# Altium schematic sheet Minion.SchDoc (part 1 of 4) (continued)
## Parts
C1  10uF/16V  [SMD_0805_CAPC2012X145N]
C1P_1  10uF/16V  [SMD_0805_CAPC2012X145N]
C1P_2  10uF/16V  [SMD_0805_CAPC2012X145N]
C1P_3  10uF/16V  [SMD_0805_CAPC2012X145N]
C1P_4  10uF/16V  [SMD_0805_CAPC2012X145N]
C1P_5  10uF/16V  [SMD_0805_CAPC2012X145N]
C1P_6  10uF/16V  [SMD_0805_CAPC2012X145N]
C1P_7  10uF/16V  [SMD_0805_CAPC2012X145N]
C1P_8  10uF/16V  [SMD_0805_CAPC2012X145N]
C2  1nF  [SMD_0603_CAPC1608X80N]
C2P_1  1uF/16V  [SMD_0805_CAPC2012X145N]
C2P_2  1uF/16V  [SMD_0805_CAPC2012X145N]
C2P_3  1uF/16V  [SMD_0805_CAPC2012X145N]
C2P_4  1uF/16V  [SMD_0805_CAPC2012X145N]
C2P_5  1uF/16V  [SMD_0805_CAPC2012X145N]
C2P_6  1uF/16V  [SMD_0805_CAPC2012X145N]
C2P_7  1uF/16V  [SMD_0805_CAPC2012X145N]
C2P_8  1uF/16V  [SMD_0805_CAPC2012X145N]
C3  1nF  [SMD_0603_CAPC1608X80N]
C3P_1  100nF/50V  [SMD_0805_CAPC2012X145N]
C3P_2  100nF/50V  [SMD_0805_CAPC2012X145N]
C3P_3  100nF/50V  [SMD_0805_CAPC2012X145N]
C3P_4  100nF/50V  [SMD_0805_CAPC2012X145N]
C3P_5  100nF/50V  [SMD_0805_CAPC2012X145N]
C3P_6  100nF/50V  [SMD_0805_CAPC2012X145N]
C3P_7  100nF/50V  [SMD_0805_CAPC2012X145N]
C3P_8  100nF/50V  [SMD_0805_CAPC2012X145N]
C4  100nF  [SMD_0603_CAPC1608X80N]
C4P_1  22uF/16V  [SMD_1210_CAPC3225X279N]
C4P_2  22uF/16V  [SMD_1210_CAPC3225X279N]
C4P_3  22uF/16V  [SMD_1210_CAPC3225X279N]
C4P_4  22uF/16V  [SMD_1210_CAPC3225X279N]
C4P_5  22uF/16V  [SMD_1210_CAPC3225X279N]
C4P_6  22uF/16V  [SMD_1210_CAPC3225X279N]
C4P_7  22uF/16V  [SMD_1210_CAPC3225X279N]
C4P_8  22uF/16V  [SMD_1210_CAPC3225X279N]
C5P_1  22uF/16V  [SMD_1210_CAPC3225X279N]
C5P_2  22uF/16V  [SMD_1210_CAPC3225X279N]
C5P_3  22uF/16V  [SMD_1210_CAPC3225X279N]
C5P_4  22uF/16V  [SMD_1210_CAPC3225X279N]
C5P_5  22uF/16V  [SMD_1210_CAPC3225X279N]
C5P_6  22uF/16V  [SMD_1210_CAPC3225X279N]
C5P_7  22uF/16V  [SMD_1210_CAPC3225X279N]
C5P_8  22uF/16V  [SMD_1210_CAPC3225X279N]
C6P_1  220uF  [SMD_1210_CAPC3225X279N]
C6P_2  220uF  [SMD_1210_CAPC3225X279N]
C6P_3  220uF  [SMD_1210_CAPC3225X279N]
C6P_4  220uF  [SMD_1210_CAPC3225X279N]
C6P_5  220uF  [SMD_1210_CAPC3225X279N]
C6P_6  220uF  [SMD_1210_CAPC3225X279N]
C6P_7  220uF  [SMD_1210_CAPC3225X279N]
C6P_8  220uF  [SMD_1210_CAPC3225X279N]
C7  100nF  [SMD_0603_CAPC1608X80N]
C7P_1  220uF  [SMD_1210_CAPC3225X279N]
C7P_2  220uF  [SMD_1210_CAPC3225X279N]
C7P_3  220uF  [SMD_1210_CAPC3225X279N]
C7P_4  220uF  [SMD_1210_CAPC3225X279N]
C7P_5  220uF  [SMD_1210_CAPC3225X279N]
C7P_6  220uF  [SMD_1210_CAPC3225X279N]
C7P_7  220uF  [SMD_1210_CAPC3225X279N]
C7P_8  220uF  [SMD_1210_CAPC3225X279N]
C8  100nF  [SMD_0603_CAPC1608X80N]
C8P_1  220uF  [SMD_1210_CAPC3225X279N]
C8P_2  220uF  [SMD_1210_CAPC3225X279N]
C8P_3  220uF  [SMD_1210_CAPC3225X279N]
C8P_4  220uF  [SMD_1210_CAPC3225X279N]
C8P_5  220uF  [SMD_1210_CAPC3225X279N]
C8P_6  220uF  [SMD_1210_CAPC3225X279N]
C8P_7  220uF  [SMD_1210_CAPC3225X279N]
C8P_8  220uF  [SMD_1210_CAPC3225X279N]
C9  100nF  [SMD_0603_CAPC1608X80N]
C9P_1  22uF/16V  [SMD_1210_CAPC3225X279N]
C9P_2  22uF/16V  [SMD_1210_CAPC3225X279N]
C9P_3  22uF/16V  [SMD_1210_CAPC3225X279N]
C9P_4  22uF/16V  [SMD_1210_CAPC3225X279N]
C9P_5  22uF/16V  [SMD_1210_CAPC3225X279N]
C9P_6  22uF/16V  [SMD_1210_CAPC3225X279N]
C9P_7  22uF/16V  [SMD_1210_CAPC3225X279N]
C9P_8  22uF/16V  [SMD_1210_CAPC3225X279N]
C10  100nF  [SMD_0603_CAPC1608X80N]
C10P_1  22uF/16V  [SMD_1210_CAPC3225X279N]
C10P_2  22uF/16V  [SMD_1210_CAPC3225X279N]
C10P_3  22uF/16V  [SMD_1210_CAPC3225X279N]
C10P_4  22uF/16V  [SMD_1210_CAPC3225X279N]
C10P_5  22uF/16V  [SMD_1210_CAPC3225X279N]
C10P_6  22uF/16V  [SMD_1210_CAPC3225X279N]
C10P_7  22uF/16V  [SMD_1210_CAPC3225X279N]
C10P_8  22uF/16V  [SMD_1210_CAPC3225X279N]
C11  100nF  [SMD_0603_CAPC1608X80N]
C11P_1  22uF/16V  [SMD_1210_CAPC3225X279N]
C11P_2  22uF/16V  [SMD_1210_CAPC3225X279N]
C11P_3  22uF/16V  [SMD_1210_CAPC3225X279N]
C11P_4  22uF/16V  [SMD_1210_CAPC3225X279N]
C11P_5  22uF/16V  [SMD_1210_CAPC3225X279N]
C11P_6  22uF/16V  [SMD_1210_CAPC3225X279N]
C11P_7  22uF/16V  [SMD_1210_CAPC3225X279N]
C11P_8  22uF/16V  [SMD_1210_CAPC3225X279N]
C12  18pF  [SMD_0603_CAPC1608X80N]
C12P_1  22uF/16V  [SMD_1210_CAPC3225X279N]
C12P_2  22uF/16V  [SMD_1210_CAPC3225X279N]
C12P_3  22uF/16V  [SMD_1210_CAPC3225X279N]
C12P_4  22uF/16V  [SMD_1210_CAPC3225X279N]
C12P_5  22uF/16V  [SMD_1210_CAPC3225X279N]
C12P_6  22uF/16V  [SMD_1210_CAPC3225X279N]
C12P_7  22uF/16V  [SMD_1210_CAPC3225X279N]
C12P_8  22uF/16V  [SMD_1210_CAPC3225X279N]
C13  18pF  [SMD_0603_CAPC1608X80N]
C14  10uF/16V  [SMD_0805_CAPC2012X145N]
C15  10uF/16V  [SMD_0805_CAPC2012X145N]
C16  (OPT)220uF  [SMD_1210_CAPC3225X279N]
C17  22uF/6.3V  [SMD_0805_CAPC2012X145N]
C25  22uF/6.3V  [SMD_0805_CAPC2012X145N]
C26  22uF/6.3V  [SMD_0805_CAPC2012X145N]
CF_1  (OPT)1uF  [SMD_1210_CAPC3225X279N]
CF_2  (OPT)1uF  [SMD_1210_CAPC3225X279N]
CF_3  (OPT)1uF  [SMD_1210_CAPC3225X279N]
CF_4  (OPT)1uF  [SMD_1210_CAPC3225X279N]
CF_5  (OPT)1uF  [SMD_1210_CAPC3225X279N]
CF_6  (OPT)1uF  [SMD_1210_CAPC3225X279N]
CF_7  (OPT)1uF  [SMD_1210_CAPC3225X279N]
CF_8  (OPT)1uF  [SMD_1210_CAPC3225X279N]
CF_9  (OPT)1uF  [SMD_1210_CAPC3225X279N]
CF_10  (OPT)1uF  [SMD_1210_CAPC3225X279N]
CF_11  (OPT)1uF  [SMD_1210_CAPC3225X279N]
CF_12  (OPT)1uF  [SMD_1210_CAPC3225X279N]
CF_13  (OPT)1uF  [SMD_1210_CAPC3225X279N]
CF_14  (OPT)1uF  [SMD_1210_CAPC3225X279N]
CF_15  (OPT)1uF  [SMD_1210_CAPC3225X279N]
CF_16  (OPT)1uF  [SMD_1210_CAPC3225X279N]
CF_17  (OPT)1uF  [SMD_1210_CAPC3225X279N]
CF_18  (OPT)1uF  [SMD_1210_CAPC3225X279N]
CF_19  (OPT)1uF  [SMD_1210_CAPC3225X279N]
CF_20  (OPT)1uF  [SMD_1210_CAPC3225X279N]
CF_21  (OPT)1uF  [SMD_1210_CAPC3225X279N]
CF_22  (OPT)1uF  [SMD_1210_CAPC3225X279N]
CF_23  (OPT)1uF  [SMD_1210_CAPC3225X279N]
CF_24  (OPT)1uF  [SMD_1210_CAPC3225X279N]
CF_25  (OPT)1uF  [SMD_1210_CAPC3225X279N]
CF_26  (OPT)1uF  [SMD_1210_CAPC3225X279N]
CF_27  (OPT)1uF  [SMD_1210_CAPC3225X279N]
CF_28  (OPT)1uF  [SMD_1210_CAPC3225X279N]
CF_29  (OPT)1uF  [SMD_1210_CAPC3225X279N]
CF_30  (OPT)1uF  [SMD_1210_CAPC3225X279N]
CF_31  (OPT)1uF  [SMD_1210_CAPC3225X279N]
CF_32  (OPT)1uF  [SMD_1210_CAPC3225X279N]
CF_33  (OPT)1uF  [SMD_1210_CAPC3225X279N]
CF_34  (OPT)1uF  [SMD_1210_CAPC3225X279N]
CF_35  (OPT)1uF  [SMD_1210_CAPC3225X279N]
CF_36  (OPT)1uF  [SMD_1210_CAPC3225X279N]
CF_37  (OPT)1uF  [SMD_1210_CAPC3225X279N]
CF_38  (OPT)1uF  [SMD_1210_CAPC3225X279N]
CF_39  (OPT)1uF  [SMD_1210_CAPC3225X279N]
CF_40  (OPT)1uF  [SMD_1210_CAPC3225X279N]
CF_41  (OPT)1uF  [SMD_1210_CAPC3225X279N]
CF_42  (OPT)1uF  [SMD_1210_CAPC3225X279N]
CF_43  (OPT)1uF  [SMD_1210_CAPC3225X279N]
CF_44  (OPT)1uF  [SMD_1210_CAPC3225X279N]
CF_45  (OPT)1uF  [SMD_1210_CAPC3225X279N]
CF_46  (OPT)1uF  [SMD_1210_CAPC3225X279N]
CF_47  (OPT)1uF  [SMD_1210_CAPC3225X279N]
CF_48  (OPT)1uF  [SMD_1210_CAPC3225X279N]
CF_49  (OPT)1uF  [SMD_1210_CAPC3225X279N]
CF_50  (OPT)1uF  [SMD_1210_CAPC3225X279N]
CF_51  (OPT)1uF  [SMD_1210_CAPC3225X279N]
CF_52  (OPT)1uF  [SMD_1210_CAPC3225X279N]
CF_53  (OPT)1uF  [SMD_1210_CAPC3225X279N]
CF_54  (OPT)1uF  [SMD_1210_CAPC3225X279N]
CF_55  (OPT)1uF  [SMD_1210_CAPC3225X279N]
CF_56  (OPT)1uF  [SMD_1210_CAPC3225X279N]
CF_57  (OPT)1uF  [SMD_1210_CAPC3225X279N]
CF_58  (OPT)1uF  [SMD_1210_CAPC3225X279N]
CF_59  (OPT)1uF  [SMD_1210_CAPC3225X279N]
CF_60  (OPT)1uF  [SMD_1210_CAPC3225X279N]
CF_61  (OPT)1uF  [SMD_1210_CAPC3225X279N]
CF_62  (OPT)1uF  [SMD_1210_CAPC3225X279N]
CF_63  (OPT)1uF  [SMD_1210_CAPC3225X279N]
CF_64  (OPT)1uF  [SMD_1210_CAPC3225X279N]
CF_65  (OPT)1uF  [SMD_1210_CAPC3225X279N]
CF_66  (OPT)1uF  [SMD_1210_CAPC3225X279N]
CF_67  (OPT)1uF  [SMD_1210_CAPC3225X279N]
CF_68  (OPT)1uF  [SMD_1210_CAPC3225X279N]
CF_69  (OPT)1uF  [SMD_1210_CAPC3225X279N]
CF_70  (OPT)1uF  [SMD_1210_CAPC3225X279N]
CF_71  (OPT)1uF  [SMD_1210_CAPC3225X279N]
CF_72  (OPT)1uF  [SMD_1210_CAPC3225X279N]
CF_73  (OPT)1uF  [SMD_1210_CAPC3225X279N]
CF_74  (OPT)1uF  [SMD_1210_CAPC3225X279N]
CF_75  (OPT)1uF  [SMD_1210_CAPC3225X279N]
CF_76  (OPT)1uF  [SMD_1210_CAPC3225X279N]
CF_77  (OPT)1uF  [SMD_1210_CAPC3225X279N]
CF_78  (OPT)1uF  [SMD_1210_CAPC3225X279N]
CF_79  (OPT)1uF  [SMD_1210_CAPC3225X279N]
CF_80  (OPT)1uF  [SMD_1210_CAPC3225X279N]
CF_81  (OPT)1uF  [SMD_1210_CAPC3225X279N]
CF_82  (OPT)1uF  [SMD_1210_CAPC3225X279N]
CF_83  (OPT)1uF  [SMD_1210_CAPC3225X279N]
CF_84  (OPT)1uF  [SMD_1210_CAPC3225X279N]
CF_85  (OPT)1uF  [SMD_1210_CAPC3225X279N]
CF_86  (OPT)1uF  [SMD_1210_CAPC3225X279N]
CF_87  (OPT)1uF  [SMD_1210_CAPC3225X279N]
CF_88  (OPT)1uF  [SMD_1210_CAPC3225X279N]
CF_89  (OPT)1uF  [SMD_1210_CAPC3225X279N]
CF_90  (OPT)1uF  [SMD_1210_CAPC3225X279N]
CF_91  (OPT)1uF  [SMD_1210_CAPC3225X279N]
CF_92  (OPT)1uF  [SMD_1210_CAPC3225X279N]
CF_93  (OPT)1uF  [SMD_1210_CAPC3225X279N]
CF_94  (OPT)1uF  [SMD_1210_CAPC3225X279N]
CF_95  (OPT)1uF  [SMD_1210_CAPC3225X279N]
CF_96  (OPT)1uF  [SMD_1210_CAPC3225X279N]
CF_97  (OPT)1uF  [SMD_1210_CAPC3225X279N]
CF_98  (OPT)1uF  [SMD_1210_CAPC3225X279N]
CF_99  (OPT)1uF  [SMD_1210_CAPC3225X279N]
CF_100  (OPT)1uF  [SMD_1210_CAPC3225X279N]
CF_101  (OPT)1uF  [SMD_1210_CAPC3225X279N]
CF_102  (OPT)1uF  [SMD_1210_CAPC3225X279N]
CF_103  (OPT)1uF  [SMD_1210_CAPC3225X279N]
CF_104  (OPT)1uF  [SMD_1210_CAPC3225X279N]
CF_105  (OPT)1uF  [SMD_1210_CAPC3225X279N]
CF_106  (OPT)1uF  [SMD_1210_CAPC3225X279N]
CF_107  (OPT)1uF  [SMD_1210_CAPC3225X279N]
CF_108  (OPT)1uF  [SMD_1210_CAPC3225X279N]
CF_109  (OPT)1uF  [SMD_1210_CAPC3225X279N]
CF_110  (OPT)1uF  [SMD_1210_CAPC3225X279N]
CF_111  (OPT)1uF  [SMD_1210_CAPC3225X279N]
CF_112  (OPT)1uF  [SMD_1210_CAPC3225X279N]
CM_1  1uF  [SMD_1210_CAPC3225X279N]
CM_2  1uF  [SMD_1210_CAPC3225X279N]
CM_3  1uF  [SMD_1210_CAPC3225X279N]
CM_4  1uF  [SMD_1210_CAPC3225X279N]
CM_5  1uF  [SMD_1210_CAPC3225X279N]
CM_6  1uF  [SMD_1210_CAPC3225X279N]
CM_7  1uF  [SMD_1210_CAPC3225X279N]
CM_8  1uF  [SMD_1210_CAPC3225X279N]
CM_9  1uF  [SMD_1210_CAPC3225X279N]
CM_10  1uF  [SMD_1210_CAPC3225X279N]
CM_11  1uF  [SMD_1210_CAPC3225X279N]
CM_12  1uF  [SMD_1210_CAPC3225X279N]
CM_13  1uF  [SMD_1210_CAPC3225X279N]
CM_14  1uF  [SMD_1210_CAPC3225X279N]
CM_15  1uF  [SMD_1210_CAPC3225X279N]
CM_16  1uF  [SMD_1210_CAPC3225X279N]
CM_17  1uF  [SMD_1210_CAPC3225X279N]
CM_18  1uF  [SMD_1210_CAPC3225X279N]
CM_19  1uF  [SMD_1210_CAPC3225X279N]
CM_20  1uF  [SMD_1210_CAPC3225X279N]
CM_21  1uF  [SMD_1210_CAPC3225X279N]
CM_22  1uF  [SMD_1210_CAPC3225X279N]
CM_23  1uF  [SMD_1210_CAPC3225X279N]
CM_24  1uF  [SMD_1210_CAPC3225X279N]
CM_25  1uF  [SMD_1210_CAPC3225X279N]
CM_26  1uF  [SMD_1210_CAPC3225X279N]
CM_27  1uF  [SMD_1210_CAPC3225X279N]
CM_28  1uF  [SMD_1210_CAPC3225X279N]
CM_29  1uF  [SMD_1210_CAPC3225X279N]
CM_30  1uF  [SMD_1210_CAPC3225X279N]
CM_31  1uF  [SMD_1210_CAPC3225X279N]
CM_32  1uF  [SMD_1210_CAPC3225X279N]
CM_33  1uF  [SMD_1210_CAPC3225X279N]
CM_34  1uF  [SMD_1210_CAPC3225X279N]
CM_35  1uF  [SMD_1210_CAPC3225X279N]
CM_36  1uF  [SMD_1210_CAPC3225X279N]
CM_37  1uF  [SMD_1210_CAPC3225X279N]
CM_38  1uF  [SMD_1210_CAPC3225X279N]
CM_39  1uF  [SMD_1210_CAPC3225X279N]
CM_40  1uF  [SMD_1210_CAPC3225X279N]
CM_41  1uF  [SMD_1210_CAPC3225X279N]
CM_42  1uF  [SMD_1210_CAPC3225X279N]
CM_43  1uF  [SMD_1210_CAPC3225X279N]
CM_44  1uF  [SMD_1210_CAPC3225X279N]
CM_45  1uF  [SMD_1210_CAPC3225X279N]
CM_46  1uF  [SMD_1210_CAPC3225X279N]
CM_47  1uF  [SMD_1210_CAPC3225X279N]
CM_48  1uF  [SMD_1210_CAPC3225X279N]
CM_49  1uF  [SMD_1210_CAPC3225X279N]
CM_50  1uF  [SMD_1210_CAPC3225X279N]
CM_51  1uF  [SMD_1210_CAPC3225X279N]
CM_52  1uF  [SMD_1210_CAPC3225X279N]
CM_53  1uF  [SMD_1210_CAPC3225X279N]
CM_54  1uF  [SMD_1210_CAPC3225X279N]
CM_55  1uF  [SMD_1210_CAPC3225X279N]
CM_56  1uF  [SMD_1210_CAPC3225X279N]
CM_57  1uF  [SMD_1210_CAPC3225X279N]
CM_58  1uF  [SMD_1210_CAPC3225X279N]
CM_59  1uF  [SMD_1210_CAPC3225X279N]
CM_60  1uF  [SMD_1210_CAPC3225X279N]
CM_61  1uF  [SMD_1210_CAPC3225X279N]
CM_62  1uF  [SMD_1210_CAPC3225X279N]
CM_63  1uF  [SMD_1210_CAPC3225X279N]
CM_64  1uF  [SMD_1210_CAPC3225X279N]
CM_65  1uF  [SMD_1210_CAPC3225X279N]
CM_66  1uF  [SMD_1210_CAPC3225X279N]
CM_67  1uF  [SMD_1210_CAPC3225X279N]
CM_68  1uF  [SMD_1210_CAPC3225X279N]
CM_69  1uF  [SMD_1210_CAPC3225X279N]
CM_70  1uF  [SMD_1210_CAPC3225X279N]
CM_71  1uF  [SMD_1210_CAPC3225X279N]
CM_72  1uF  [SMD_1210_CAPC3225X279N]
CM_73  1uF  [SMD_1210_CAPC3225X279N]
CM_74  1uF  [SMD_1210_CAPC3225X279N]
CM_75  1uF  [SMD_1210_CAPC3225X279N]
CM_76  1uF  [SMD_1210_CAPC3225X279N]
CM_77  1uF  [SMD_1210_CAPC3225X279N]
CM_78  1uF  [SMD_1210_CAPC3225X279N]
CM_79  1uF  [SMD_1210_CAPC3225X279N]
CM_80  1uF  [SMD_1210_CAPC3225X279N]
CM_81  1uF  [SMD_1210_CAPC3225X279N]
CM_82  1uF  [SMD_1210_CAPC3225X279N]
CM_83  1uF  [SMD_1210_CAPC3225X279N]
CM_84  1uF  [SMD_1210_CAPC3225X279N]
CM_85  1uF  [SMD_1210_CAPC3225X279N]
CM_86  1uF  [SMD_1210_CAPC3225X279N]
CM_87  1uF  [SMD_1210_CAPC3225X279N]
CM_88  1uF  [SMD_1210_CAPC3225X279N]
CM_89  1uF  [SMD_1210_CAPC3225X279N]
CM_90  1uF  [SMD_1210_CAPC3225X279N]
CM_91  1uF  [SMD_1210_CAPC3225X279N]
CM_92  1uF  [SMD_1210_CAPC3225X279N]
CM_93  1uF  [SMD_1210_CAPC3225X279N]
CM_94  1uF  [SMD_1210_CAPC3225X279N]
CM_95  1uF  [SMD_1210_CAPC3225X279N]
CM_96  1uF  [SMD_1210_CAPC3225X279N]
CM_97  1uF  [SMD_1210_CAPC3225X279N]
CM_98  1uF  [SMD_1210_CAPC3225X279N]
CM_99  1uF  [SMD_1210_CAPC3225X279N]
CM_100  1uF  [SMD_1210_CAPC3225X279N]
CM_101  1uF  [SMD_1210_CAPC3225X279N]
CM_102  1uF  [SMD_1210_CAPC3225X279N]
CM_103  1uF  [SMD_1210_CAPC3225X279N]
CM_104  1uF  [SMD_1210_CAPC3225X279N]
CM_105  1uF  [SMD_1210_CAPC3225X279N]
CM_106  1uF  [SMD_1210_CAPC3225X279N]
CM_107  1uF  [SMD_1210_CAPC3225X279N]
CM_108  1uF  [SMD_1210_CAPC3225X279N]
CM_109  1uF  [SMD_1210_CAPC3225X279N]
CM_110  1uF  [SMD_1210_CAPC3225X279N]
CM_111  1uF  [SMD_1210_CAPC3225X279N]
CM_112  1uF  [SMD_1210_CAPC3225X279N]
CO1_1  1nF  [SMD_0603_CAPC1608X80N]
CO1_2  1nF  [SMD_0603_CAPC1608X80N]
CO1_3  1nF  [SMD_0603_CAPC1608X80N]
CO1_4  1nF  [SMD_0603_CAPC1608X80N]
CO2_1  100nF  [SMD_0603_CAPC1608X80N]
CO2_2  100nF  [SMD_0603_CAPC1608X80N]
CO2_3  100nF  [SMD_0603_CAPC1608X80N]
CO2_4  100nF  [SMD_0603_CAPC1608X80N]
CO3_1  220uF  [SMD_1210_CAPC3225X279N]
CO3_2  220uF  [SMD_1210_CAPC3225X279N]
CO3_3  220uF  [SMD_1210_CAPC3225X279N]
CO3_4  220uF  [SMD_1210_CAPC3225X279N]
CO4_1  22uF/6.3V  [SMD_0805_CAPC2012X145N]
CO4_2  22uF/6.3V  [SMD_0805_CAPC2012X145N]
CO4_3  22uF/6.3V  [SMD_0805_CAPC2012X145N]
CO4_4  22uF/6.3V  [SMD_0805_CAPC2012X145N]
CO5_1  (OPT)1nF  [SMD_0603_CAPC1608X80N]
CO5_2  (OPT)1nF  [SMD_0603_CAPC1608X80N]
CO5_3  (OPT)1nF  [SMD_0603_CAPC1608X80N]
CO5_4  (OPT)1nF  [SMD_0603_CAPC1608X80N]
CO6_1  (OPT)1nF  [SMD_0603_CAPC1608X80N]
CO6_2  (OPT)1nF  [SMD_0603_CAPC1608X80N]
CO6_3  (OPT)1nF  [SMD_0603_CAPC1608X80N]
CO6_4  (OPT)1nF  [SMD_0603_CAPC1608X80N]
CO7_1  470nF  [SMD_0603_CAPC1608X80N]
CO7_2  470nF  [SMD_0603_CAPC1608X80N]
CO7_3  470nF  [SMD_0603_CAPC1608X80N]
CO7_4  470nF  [SMD_0603_CAPC1608X80N]
CO8_1  100nF  [SMD_0603_CAPC1608X80N]
CO8_2  100nF  [SMD_0603_CAPC1608X80N]
CO8_3  100nF  [SMD_0603_CAPC1608X80N]
CO8_4  100nF  [SMD_0603_CAPC1608X80N]
D1  Red SML210VT ROHM  [SMD_0805_LED2012X100N]
D1P_1  BAT54C  [SMD_SOT23_SOT95P240X120-3N]
D1P_2  BAT54C  [SMD_SOT23_SOT95P240X120-3N]
D1P_3  BAT54C  [SMD_SOT23_SOT95P240X120-3N]
D1P_4  BAT54C  [SMD_SOT23_SOT95P240X120-3N]
D1P_5  BAT54C  [SMD_SOT23_SOT95P240X120-3N]
D1P_6  BAT54C  [SMD_SOT23_SOT95P240X120-3N]
D1P_7  BAT54C  [SMD_SOT23_SOT95P240X120-3N]
D1P_8  BAT54C  [SMD_SOT23_SOT95P240X120-3N]
D2  Green 	SML210MT ROHM  [SMD_0805_LED2012X100N]
D3  Yellow SML210YT ROHM  [SMD_0805_LED2012X100N]
D4  Orange 	SML210DT ROHM  [SMD_0805_LED2012X100N]
D5  SMS05T1G  [SMD_SOT95P280X145-6N-W]
D6  SMCJ12A  [SMD_DO214AC_SMC]
D7  (OPT)SS14  [SMD_DO214AC_SMA]
D8  (OPT)SS14  [SMD_DO214AC_SMA]
D9  SS14  [SMD_DO214AC_SMA]
D10  SMCJ12A  [SMD_DO214AC_SMC]
D11  SMCJ12A  [SMD_DO214AC_SMC]
D12  SMCJ12A  [SMD_DO214AC_SMC]
DI1_1  Red SML210VT ROHM  [SMD_0805_LED2012X100N]
DI1_2  Red SML210VT ROHM  [SMD_0805_LED2012X100N]
DI1_3  Red SML210VT ROHM  [SMD_0805_LED2012X100N]
DI1_4  Red SML210VT ROHM  [SMD_0805_LED2012X100N]
DI2_1  Green 	SML210MT ROHM  [SMD_0805_LED2012X100N]
DI2_2  Green 	SML210MT ROHM  [SMD_0805_LED2012X100N]
DI2_3  Green 	SML210MT ROHM  [SMD_0805_LED2012X100N]
DI2_4  Green 	SML210MT ROHM  [SMD_0805_LED2012X100N]
DI3_1  Yellow SML210YT ROHM  [SMD_0805_LED2012X100N]
DI3_2  Yellow SML210YT ROHM  [SMD_0805_LED2012X100N]
DI3_3  Yellow SML210YT ROHM  [SMD_0805_LED2012X100N]
DI3_4  Yellow SML210YT ROHM  [SMD_0805_LED2012X100N]
DI4_1  (OPT)Orange 	SML210DT ROHM  [SMD_0805_LED2012X100N]
DI4_2  (OPT)Orange 	SML210DT ROHM  [SMD_0805_LED2012X100N]
DI4_3  (OPT)Orange 	SML210DT ROHM  [SMD_0805_LED2012X100N]
DI4_4  (OPT)Orange 	SML210DT ROHM  [SMD_0805_LED2012X100N]
DI5_1  (OPT)Red SML210VT ROHM  [SMD_0805_LED2012X100N]
DI5_2  (OPT)Red SML210VT ROHM  [SMD_0805_LED2012X100N]
DI5_3  (OPT)Red SML210VT ROHM  [SMD_0805_LED2012X100N]
DI5_4  (OPT)Red SML210VT ROHM  [SMD_0805_LED2012X100N]
DI6_1  (OPT)Green 	SML210MT ROHM  [SMD_0805_LED2012X100N]
DI6_2  (OPT)Green 	SML210MT ROHM  [SMD_0805_LED2012X100N]
DI6_3  (OPT)Green 	SML210MT ROHM  [SMD_0805_LED2012X100N]
DI6_4  (OPT)Green 	SML210MT ROHM  [SMD_0805_LED2012X100N]
DI7_1  (OPT)Yellow SML210YT ROHM  [SMD_0805_LED2012X100N]
DI7_2  (OPT)Yellow SML210YT ROHM  [SMD_0805_LED2012X100N]
DI7_3  (OPT)Yellow SML210YT ROHM  [SMD_0805_LED2012X100N]
DI7_4  (OPT)Yellow SML210YT ROHM  [SMD_0805_LED2012X100N]
DI8_1  Orange 	SML210DT ROHM  [SMD_0805_LED2012X100N]
DI8_2  Orange 	SML210DT ROHM  [SMD_0805_LED2012X100N]
DI8_3  Orange 	SML210DT ROHM  [SMD_0805_LED2012X100N]
DI8_4  Orange 	SML210DT ROHM  [SMD_0805_LED2012X100N]
DI9_1  (OPT)Yellow SML210YT ROHM  [SMD_0805_LED2012X100N]
DI9_2  (OPT)Yellow SML210YT ROHM  [SMD_0805_LED2012X100N]
DI9_3  (OPT)Yellow SML210YT ROHM  [SMD_0805_LED2012X100N]
DI9_4  (OPT)Yellow SML210YT ROHM  [SMD_0805_LED2012X100N]
J1  (OPT) CON PROGRAM  [SIP5 PGM TOP]
J2  CU04SCM15B0-R0  [SMD_CON-CVILUX-CU04-SCM15B0]
J4  WURTH 649 006 295 22  [PTH_CON_PCI-E]
J5  BGA FAN  [SMD_BGA900_FAN]
J6  BGA FAN  [SMD_BGA900_FAN]
J7  BGA FAN  [SMD_BGA900_FAN]
J8  BGA FAN  [SMD_BGA900_FAN]
J9  WURTH 649 006 295 22  [PTH_CON_PCI-E]
J10  WURTH 649 006 295 22  [PTH_CON_PCI-E]
J12  CON FAN  [PTH_CON_PANCON-MPSS100-04D]
J13  CON FAN  [PTH_CON_PANCON-MPSS100-04D]
J14  CON FAN  [PTH_CON_PANCON-MPSS100-04D]
J15  CON FAN  [PTH_CON_PANCON-MPSS100-04D]
L1P_1  SLC1480-201MLD  [SMD_INDM12501250X800A - Coilcraft SLC1480]
L1P_2  SLC1480-201MLD  [SMD_INDM12501250X800A - Coilcraft SLC1480]
L1P_3  SLC1480-201MLD  [SMD_INDM12501250X800A - Coilcraft SLC1480]
L1P_4  SLC1480-201MLD  [SMD_INDM12501250X800A - Coilcraft SLC1480]
L1P_5  SLC1480-201MLD  [SMD_INDM12501250X800A - Coilcraft SLC1480]
L1P_6  SLC1480-201MLD  [SMD_INDM12501250X800A - Coilcraft SLC1480]
L1P_7  SLC1480-201MLD  [SMD_INDM12501250X800A - Coilcraft SLC1480]
L1P_8  SLC1480-201MLD  [SMD_INDM12501250X800A - Coilcraft SLC1480]
Q1P_1  AP1RA03GMT-3  [SMD_SON127P615X520X100-8N]
Q1P_2  AP1RA03GMT-3  [SMD_SON127P615X520X100-8N]
Q1P_3  AP1RA03GMT-3  [SMD_SON127P615X520X100-8N]
Q1P_4  AP1RA03GMT-3  [SMD_SON127P615X520X100-8N]
Q1P_5  AP1RA03GMT-3  [SMD_SON127P615X520X100-8N]
Q1P_6  AP1RA03GMT-3  [SMD_SON127P615X520X100-8N]
Q1P_7  AP1RA03GMT-3  [SMD_SON127P615X520X100-8N]
Q1P_8  AP1RA03GMT-3  [SMD_SON127P615X520X100-8N]
Q2P_1  AP1RA03GMT-3  [SMD_SON127P615X520X100-8N]
Q2P_2  AP1RA03GMT-3  [SMD_SON127P615X520X100-8N]
Q2P_3  AP1RA03GMT-3  [SMD_SON127P615X520X100-8N]
Q2P_4  AP1RA03GMT-3  [SMD_SON127P615X520X100-8N]
Q2P_5  AP1RA03GMT-3  [SMD_SON127P615X520X100-8N]
Q2P_6  AP1RA03GMT-3  [SMD_SON127P615X520X100-8N]
Q2P_7  AP1RA03GMT-3  [SMD_SON127P615X520X100-8N]
Q2P_8  AP1RA03GMT-3  [SMD_SON127P615X520X100-8N]
Q3P_1  AP1RA03GMT-3  [SMD_SON127P615X520X100-8N]
Q3P_2  AP1RA03GMT-3  [SMD_SON127P615X520X100-8N]
Q3P_3  AP1RA03GMT-3  [SMD_SON127P615X520X100-8N]
Q3P_4  AP1RA03GMT-3  [SMD_SON127P615X520X100-8N]
Q3P_5  AP1RA03GMT-3  [SMD_SON127P615X520X100-8N]
Q3P_6  AP1RA03GMT-3  [SMD_SON127P615X520X100-8N]
Q3P_7  AP1RA03GMT-3  [SMD_SON127P615X520X100-8N]
Q3P_8  AP1RA03GMT-3  [SMD_SON127P615X520X100-8N]
QO1_1  (OPT)BSS138  [SMD_SOT23_SOT95P240X120-3N]
QO1_2  (OPT)BSS138  [SMD_SOT23_SOT95P240X120-3N]
QO1_3  (OPT)BSS138  [SMD_SOT23_SOT95P240X120-3N]
QO1_4  (OPT)BSS138  [SMD_SOT23_SOT95P240X120-3N]
R1  10k  [SMD_0603_RESC1608X55N]
R2  10k  [SMD_0603_RESC1608X55N]
R3  10k  [SMD_0603_RESC1608X55N]
R4  10k  [SMD_0603_RESC1608X55N]
R9  10k  [SMD_0603_RESC1608X55N]
R10  10k  [SMD_0603_RESC1608X55N]
R11  10k  [SMD_0603_RESC1608X55N]
R12  10k  [SMD_0603_RESC1608X55N]
R15  10k  [SMD_0603_RESC1608X55N]
R16  2.4k  [SMD_0603_RESC1608X55N]
R17  0  [SMD_0603_RESC1608X55N]
R18  10k  [SMD_0603_RESC1608X55N]
R22  10k  [SMD_0603_RESC1608X55N]
R23  10k  [SMD_0603_RESC1608X55N]
R25  0  [SMD_0603_RESC1608X55N]
R26  2  [SMD_1206_RESC3216X180N]
R27  0  [SMD_0603_RESC1608X55N]
R28  100  [SMD_1206_RESC3216X180N]
R29  47  [SMD_0603_RESC1608X55N]
R30  (OPT)0  [SMD_0603_RESC1608X55N]
R31  47  [SMD_0603_RESC1608X55N]
RI1_1  0  [SMD_0603_RESC1608X55N]
RI1_2  0  [SMD_0603_RESC1608X55N]
RI1_3  0  [SMD_0603_RESC1608X55N]
RI1_4  0  [SMD_0603_RESC1608X55N]
RI2_1  0  [SMD_0603_RESC1608X55N]
RI2_2  0  [SMD_0603_RESC1608X55N]
RI2_3  0  [SMD_0603_RESC1608X55N]
RI2_4  0  [SMD_0603_RESC1608X55N]
RO1_1  (OPT)0  [SMD_0603_RESC1608X55N]
RO1_2  (OPT)0  [SMD_0603_RESC1608X55N]
RO1_3  (OPT)0  [SMD_0603_RESC1608X55N]
RO1_4  (OPT)0  [SMD_0603_RESC1608X55N]
RO2_1  (OPT)1k  [SMD_0603_RESC1608X55N]
RO2_2  (OPT)1k  [SMD_0603_RESC1608X55N]
RO2_3  (OPT)1k  [SMD_0603_RESC1608X55N]
RO2_4  (OPT)1k  [SMD_0603_RESC1608X55N]
RO3_1  10k  [SMD_0603_RESC1608X55N]
RO3_2  10k  [SMD_0603_RESC1608X55N]
RO3_3  10k  [SMD_0603_RESC1608X55N]
RO3_4  10k  [SMD_0603_RESC1608X55N]
U1  dsPIC33EP256MU806  [SMD_QFP50P1200X1200X120-64N]
U1_1  Minion BGA  [SMD_BGA900C80P30X30_2500X2500X240 -  FANOUT]
U1_2  Minion BGA  [SMD_BGA900C80P30X30_2500X2500X240 -  FANOUT]
U1_3  Minion BGA  [SMD_BGA900C80P30X30_2500X2500X240 -  FANOUT]
U1_4  Minion BGA  [SMD_BGA900C80P30X30_2500X2500X240 -  FANOUT]
U1P_1  LTC 4449  [SMD_DFN16166SON50P161X161X60-9N - LTC4449]
U1P_2  LTC 4449  [SMD_DFN16166SON50P161X161X60-9N - LTC4449]
U1P_3  LTC 4449  [SMD_DFN16166SON50P161X161X60-9N - LTC4449]
U1P_4  LTC 4449  [SMD_DFN16166SON50P161X161X60-9N - LTC4449]
U1P_5  LTC 4449  [SMD_DFN16166SON50P161X161X60-9N - LTC4449]
U1P_6  LTC 4449  [SMD_DFN16166SON50P161X161X60-9N - LTC4449]
U1P_7  LTC 4449  [SMD_DFN16166SON50P161X161X60-9N - LTC4449]
U1P_8  LTC 4449  [SMD_DFN16166SON50P161X161X60-9N - LTC4449]
U2  (OPT) LM7805  [SMD_SOIC127P602X173-8N]
U3  (OPT)BU33TD3WG-TR  [SMD_SOT26_SOT95P285X140-5N - DLV]
U4  (OPT) L7805CD2T-TR  [SMD_TO254P1524X483-3_4N_D2PAK]
U5  L78M05CDT-TR  [SMD_TO229P991X239-4AN_DPAK]
U6  BD18KA5WF  [SMD_SOIC127P602X173-8N]
U7  BD33KA5WF  [SMD_SOIC127P602X173-8N]
U8  BD33KA5WF  [SMD_SOIC127P602X173-8N]
U9  (OPT)BD33KA5WF  [SMD_SOIC127P602X173-8N]
Y1  Q4.000 MHz HC-49SM SMD  [SMD_HC49_XTAL1140X480X420N]
YO1_1  (OPT)XTAL_TXC 16 MHz  [SMD_OSC_TA 7x5mm]
YO1_2  (OPT)XTAL_TXC 16 MHz  [SMD_OSC_TA 7x5mm]
YO1_3  (OPT)XTAL_TXC 16 MHz  [SMD_OSC_TA 7x5mm]
YO1_4  (OPT)XTAL_TXC 16 MHz  [SMD_OSC_TA 7x5mm]
YO2_1  (OPT)Q12.000 MHz HC-49SM SMD  [SMD_HC49_XTAL1140X480X420N]
YO2_2  (OPT)Q12.000 MHz HC-49SM SMD  [SMD_HC49_XTAL1140X480X420N]
YO2_3  (OPT)Q12.000 MHz HC-49SM SMD  [SMD_HC49_XTAL1140X480X420N]
YO2_4  (OPT)Q12.000 MHz HC-49SM SMD  [SMD_HC49_XTAL1140X480X420N]
YO3_1  (OPT)XTAL_TXC 16 MHz  [SMD_OSC_DFN_3.2x5mm]
YO3_2  (OPT)XTAL_TXC 16 MHz  [SMD_OSC_DFN_3.2x5mm]
YO3_3  (OPT)XTAL_TXC 16 MHz  [SMD_OSC_DFN_3.2x5mm]
YO3_4  (OPT)XTAL_TXC 16 MHz  [SMD_OSC_DFN_3.2x5mm]
YO4_1  XTAL_TXC 16 MHz  [SMD_OSC_DFN_2.5X3.2MM]
YO4_2  XTAL_TXC 16 MHz  [SMD_OSC_DFN_2.5X3.2MM]
YO4_3  XTAL_TXC 16 MHz  [SMD_OSC_DFN_2.5X3.2MM]
YO4_4  XTAL_TXC 16 MHz  [SMD_OSC_DFN_2.5X3.2MM]
YO5_1  (OPT)XTAL_TXC 16 MHz  [SMD_OSC_DFN_2X2.5MM]
YO5_2  (OPT)XTAL_TXC 16 MHz  [SMD_OSC_DFN_2X2.5MM]
YO5_3  (OPT)XTAL_TXC 16 MHz  [SMD_OSC_DFN_2X2.5MM]
YO5_4  (OPT)XTAL_TXC 16 MHz  [SMD_OSC_DFN_2X2.5MM]